# Altium schematic sheet schematic1.SchDoc (part 2 of 3) (continued)
## Nets (continued)
analog_out_68: U2.23(PA0-WKUP) U8.B4(VOUT3) U?#77.1(Vout)
analog_out_69: U3.77(PA15/JTDI) U8.D2(VOUT4) U?#92.1(Vout)
analog_out_70: U3.78(PC10(USART4_TX)) U8.A3(VOUT5) U?#98.1(Vout)
analog_out_71: U3.79(PC11(USART4_RX)) U8.E2(VOUT6) U?#112.1(Vout)
analog_out_72: U3.80(PC12(SDIO_CLK)) U8.A2(VOUT7) U?#117.1(Vout)
analog_out_73: U3.81(PD0) U8.A10(VOUT8) U?#132.1(Vout)
analog_out_74: U3.82(PD1) U8.C11(VOUT9) U?#137.1(Vout)
analog_out_75: U3.83(PD2(SDIO_CMD)) U8.A11(VOUT10) U?#152.1(Vout)
analog_out_76: U3.84(PD3) U8.D11(VOUT11) U?#157.1(Vout)
analog_out_77: U3.85(PD4) U8.B10(VOUT12) U?#172.1(Vout)
analog_out_78: U3.86(PD5(USART2_TX)) U8.E11(VOUT13) U?#177.1(Vout)
analog_out_79: U3.87(PD6(USART2_RX)) U8.A12(VOUT14) U?#192.1(Vout)
analog_out_80: U3.88(PD7) U8.F11(VOUT15) U?#197.1(Vout)
analog_out_81: U3.89(PB3/JTDO) U9.A1(VOUT0) U?#13.1(Vout)
analog_out_82: U3.90(PB4/JNTRST) U9.B9(VOUT1) U?#28.1(Vout)
analog_out_83: U3.91(PB5) U9.C2(VOUT2) U?#33.1(Vout)
analog_out_84: U3.92(PB6(I2C1_SCL)) U9.B4(VOUT3) U?#47.1(Vout)
analog_out_85: U3.93(PB7(I2C1_SDA)) U9.D2(VOUT4) U?#50.1(Vout)
analog_out_86: U3.95(PB8) U9.A3(VOUT5) U?#60.1(Vout)
analog_out_87: U3.96(PB9) U9.E2(VOUT6) U?#73.1(Vout)
analog_out_88: U3.97(PE0) U9.A2(VOUT7) U?#78.1(Vout)
analog_out_89: U3.98(PE1) U9.A10(VOUT8) U?#93.1(Vout)
analog_out_90: U3.1(PE2) U9.C11(VOUT9) U?#94.1(Vout)
analog_out_91: U3.2(PE3) U9.A11(VOUT10) U?#113.1(Vout)
analog_out_92: U3.3(PE4) U9.D11(VOUT11) U?#118.1(Vout)
analog_out_93: U3.4(PE5) U9.B10(VOUT12) U?#133.1(Vout)
analog_out_94: U3.5(PE6) U9.E11(VOUT13) U?#138.1(Vout)
analog_out_95: U3.7(PC13-TAMPER-RTC) U9.A12(VOUT14) U?#153.1(Vout)
analog_out_96: U3.8(PC14-OSC32_IN) U9.F11(VOUT15) U?#158.1(Vout)
analog_out_97: U3.9(PC15-OSC32_OUT) U10.A1(VOUT0) U?#173.1(Vout)
analog_out_98: U3.15(PC0(ADC123_IN10)) U10.B9(VOUT1) U?#178.1(Vout)
analog_out_99: U3.16(PC1(ADC123_IN11)) U10.C2(VOUT2) U?#193.1(Vout)
analog_out_100: U3.17(PC2(ADC123_IN12)) U10.B4(VOUT3) U?#198.1(Vout)
AVDD18: C?#155.2 C?#156.2 C?#157.2 C?#158.2 FL?#2.1 U?#6.15(AVDD18-1) U?#6.22(AVDD18) U?#6.30(AVDDC18)
D1_N: J?#1.2(TRD1-) U?#6.23(MDIN[0])
D1_P: J?#1.1(TRD1+) U?#6.24(MDIP[0])
D2_N: J?#1.4(TRD2-) U?#6.19(MDIN[1])
D2_P: J?#1.3(TRD2+) U?#6.20(MDIP[1])
D3_N: J?#1.6(TRD3-) U?#6.17(MDIN[2])
D3_P: J?#1.5(TRD3+) U?#6.18(MDIP[2])
D4_N: J?#1.8(TRD4-) U?#6.13(MDIN[3])
D4_P: J?#1.7(TRD4+) U?#6.14(MDIP[3])
dac_clk_1: bank_13.U9(IO_L6N_T0_VREF_13) U4.A6(DSCLK)
dac_clk_2: bank_13.AB11(IO_L8N_T1_13) U5.A6(DSCLK)
dac_clk_3: bank_13.Y10(IO_L10N_T1_13) U6.A6(DSCLK)
dac_clk_4: bank_13.Y8(IO_L12N_T1_MRCC_13) U7.A6(DSCLK)
dac_clk_5: bank_13.AA6(IO_L14N_T2_SRCC_13) U8.A6(DSCLK)
dac_clk_6: bank_13.AB4(IO_L16N_T2_13) U9.A6(DSCLK)
dac_clk_7: bank_13.AA4(IO_L18N_T2_13) U10.A6(DSCLK)
dac_input_1: bank_13.AB12(IO_L7N_T1_13) U4.A7(DDIN)
dac_input_2: bank_13.AB9(IO_L9N_T1_DQS_13) U5.A7(DDIN)
dac_input_3: bank_13.AA8(IO_L11N_T1_SRCC_13) U6.A7(DDIN)
dac_input_4: bank_13.Y5(IO_L13N_T2_MRCC_13) U7.A7(DDIN)
dac_input_5: bank_13.AB1(IO_L15N_T2_DQS_13) U8.A7(DDIN)
dac_input_6: bank_13.AB6(IO_L17N_T2_13) U9.A7(DDIN)
dac_input_7: bank_13.T6(IO_L19N_T3_VREF_13) U10.A7(DDIN)
digital_out_1: U1.77(PA15/JTDI) U?#14.3(~{ER}R)
digital_out_2: U1.78(PC10(USART4_TX)) U?#34.3(~{ER}R)
digital_out_3: U1.79(PC11(USART4_RX)) U?#54.3(~{ER}R)
digital_out_4: U1.80(PC12(SDIO_CLK)) U?#79.3(~{ER}R)
digital_out_5: U1.81(PD0) U?#99.3(~{ER}R)
digital_out_6: U1.82(PD1) U?#119.3(~{ER}R)
digital_out_7: U1.83(PD2(SDIO_CMD)) U?#139.3(~{ER}R)
digital_out_8: U1.84(PD3) U?#159.3(~{ER}R)
digital_out_9: U1.85(PD4) U?#179.3(~{ER}R)
digital_out_10: U1.86(PD5(USART2_TX)) U?#204.3(~{ER}R)
digital_out_11: U1.87(PD6(USART2_RX)) U?#15.3(~{ER}R)
digital_out_12: U1.88(PD7) U?#35.3(~{ER}R)
digital_out_13: U1.89(PB3/JTDO) U?#55.3(~{ER}R)
digital_out_14: U1.90(PB4/JNTRST) U?#80.3(~{ER}R)
digital_out_15: U1.91(PB5) U?#106.3(~{ER}R)
digital_out_16: U1.92(PB6(I2C1_SCL)) U?#120.3(~{ER}R)
digital_out_17: U1.93(PB7(I2C1_SDA)) U?#140.3(~{ER}R)
digital_out_18: U1.95(PB8) U?#160.3(~{ER}R)
digital_out_19: U1.96(PB9) U?#180.3(~{ER}R)
digital_out_20: U1.97(PE0)
digital_out_21: U1.98(PE1) U?#16.3(~{ER}R)
digital_out_22: U1.1(PE2) U?#36.3(~{ER}R)
digital_out_23: U1.2(PE3)
digital_out_24: U1.3(PE4) U?#84.3(~{ER}R)
digital_out_25: U1.4(PE5) U?#100.3(~{ER}R)
digital_out_26: U1.5(PE6) U?#121.3(~{ER}R)
digital_out_27: U1.7(PC13-TAMPER-RTC) U?#141.3(~{ER}R)
digital_out_28: U1.8(PC14-OSC32_IN) U?#161.3(~{ER}R)
digital_out_29: U1.9(PC15-OSC32_OUT) U?#181.3(~{ER}R)
digital_out_30: U1.15(PC0(ADC123_IN10)) U?#208.3(~{ER}R)
digital_out_31: U1.16(PC1(ADC123_IN11)) U?#17.3(~{ER}R)
digital_out_32: U1.17(PC2(ADC123_IN12)) U?#37.3(~{ER}R)
digital_out_33: U1.18(PC3(ADC123_IN13)) U?#62.3(~{ER}R)
digital_out_34: U1.23(PA0-WKUP) U?#85.3(~{ER}R)
digital_out_35: U?#101.3(~{ER}R)
digital_out_36: U?#122.3(~{ER}R)
digital_out_37: U?#142.3(~{ER}R)
digital_out_38: U?#162.3(~{ER}R)
digital_out_39: U?#182.3(~{ER}R)
digital_out_40: U?#199.3(~{ER}R)
digital_out_41: U?#18.3(~{ER}R)
digital_out_42: U?#38.3(~{ER}R)
digital_out_43: U?#63.3(~{ER}R)
digital_out_44: U?#81.3(~{ER}R)
digital_out_45: U?#102.3(~{ER}R)
digital_out_46: U?#123.3(~{ER}R)
digital_out_47: U?#143.3(~{ER}R)
digital_out_48: U?#163.3(~{ER}R)
digital_out_49: U?#183.3(~{ER}R)
digital_out_50: U?#200.3(~{ER}R)
digital_out_51: U?#19.3(~{ER}R)
digital_out_52: U?#39.3(~{ER}R)
digital_out_53: U?#64.3(~{ER}R)
digital_out_54: U?#82.3(~{ER}R)
digital_out_55: U?#103.3(~{ER}R)
digital_out_56: U?#124.3(~{ER}R)
digital_out_57: U?#144.3(~{ER}R)
digital_out_58: U?#164.3(~{ER}R)
digital_out_59: U?#184.3(~{ER}R)
digital_out_60: U?#201.3(~{ER}R)
digital_out_61: U?#20.3(~{ER}R)
digital_out_62: U?#40.3(~{ER}R)
digital_out_63: U?#65.3(~{ER}R)
digital_out_64: U?#83.3(~{ER}R)
digital_out_65: U?#104.3(~{ER}R)
digital_out_66: U?#125.3(~{ER}R)
digital_out_67: U?#145.3(~{ER}R)
digital_out_68: U?#165.3(~{ER}R)
digital_out_69: U?#185.3(~{ER}R)
digital_out_70: U?#202.3(~{ER}R)
digital_out_71: U?#21.3(~{ER}R)
digital_out_72: U?#41.3(~{ER}R)
digital_out_73: U?#66.3(~{ER}R)
digital_out_74: U?#86.3(~{ER}R)
digital_out_75: U?#107.3(~{ER}R)
digital_out_76: U?#126.3(~{ER}R)
digital_out_77: U?#146.3(~{ER}R)
digital_out_78: U?#167.3(~{ER}R)
digital_out_79: U?#187.3(~{ER}R)
digital_out_80: U?#206.3(~{ER}R)
digital_out_81: U?#22.3(~{ER}R)
digital_out_82: U?#42.3(~{ER}R)
digital_out_83: U?#67.3(~{ER}R)
digital_out_84: U?#87.3(~{ER}R)
digital_out_85: U?#108.3(~{ER}R)
digital_out_86: U?#127.3(~{ER}R)
digital_out_87: U?#147.3(~{ER}R)
digital_out_88: U?#168.3(~{ER}R)
digital_out_89: U?#188.3(~{ER}R)
ETH-LDL: J?#1.12(YK) R?#172.1
ETH-LDR: J?#1.14(GK) R?#174.1
ETH-MDC: U?#5.A8(PS_MIO20_501) U?#6.4(MDC) ; port ETH-MDC
ETH-MDIO: R?#178.1 U?#5.E10(PS_MIO19_501) U?#6.5(MDIO) ; port ETH-MDIO
ETH-RXCK: U?#5.A6(PS_MIO13_500) U?#6.40(RX_CLK) ; port ETH-RXCK
ETH-RXCTL: U?#5.A7(PS_MIO18_501) U?#6.37(RX_CTRL) ; port ETH-RXCTL
ETH-RXD0: U?#5.B6(PS_MIO14_500) U?#6.38(RXD[0]) ; port ETH-RXD0
ETH-RXD1: U?#5.E6(PS_MIO15_500) U?#6.39(RXD[1]) ; port ETH-RXD1
ETH-RXD2: U?#5.D6(PS_MIO16_501) U?#6.41(RXD[2]) ; port ETH-RXD2
ETH-RXD3: U?#5.E9(PS_MIO17_501) U?#6.42(RXD[3]) ; port ETH-RXD3
ETH-TXCK: U?#5.D5(PS_MIO7_500) ; port ETH-TXCK
ETH-TXCK: U?#6.47(TX_CLK) ; port ETH_TXCK  [a separate net that carries the same name]
ETH-TXCTL: U?#5.C5(PS_MIO12_500) U?#6.2(TX_CTRL) ; port ETH-TXCTL
ETH-TXD0: U?#5.E5(PS_MIO8_500) U?#6.44(TXD[0]) ; port ETH-TXD0
ETH-TXD1: U?#5.C4(PS_MIO9_500) U?#6.45(TXD[1]) ; port ETH-TXD1
ETH-TXD2: U?#5.G7(PS_MIO10_500) U?#6.48(TXD[2]) ; port ETH-TXD2
ETH-TXD3: U?#5.B4(PS_MIO11_500) U?#6.1(TXD[3]) ; port ETH-TXD3
ETHAVDD: C?#161.1 FL?#3.2
in_a_1: p5.1 U4.M4(VIN0)
in_a_2: p5.2 U4.L5(VIN1)
in_a_3: p5.3 U4.L3(VIN2)
in_a_4: p5.4 U4.L4(VIN3)
in_a_5: p5.5 U4.L2(VIN4)
in_a_6: p5.6 U4.G2(VIN5)
in_a_7: p5.7 U4.K2(VIN6)
in_a_8: p5.8 U4.J2(VIN7)
in_a_9: p5.9 U4.B2(VIN8)
in_a_10: p5.10 U4.B3(VIN9)
in_a_11: p5.11 U4.B11(VIN10)
in_a_12: p5.12 U4.L11(VIN11)
in_a_13: p5.13 U4.B12(VIN12)
in_a_14: p5.14 U4.L10(VIN13)
in_a_15: p5.15 U4.K11(VIN14)
in_a_16: p5.16 U4.H11(VIN15)
in_a_17: p5.17 U5.M4(VIN0)
in_a_18: p5.18 U5.L5(VIN1)
in_a_19: p5.19 U5.L3(VIN2)
in_a_20: p5.20 U5.L4(VIN3)
in_a_21: p5.21 U5.L2(VIN4)
in_a_22: p5.22 U5.G2(VIN5)
in_a_23: p5.23 U5.K2(VIN6)
in_a_24: p5.24 U5.J2(VIN7)
in_a_25: p5.25 U5.B2(VIN8)
in_a_26: p5.26 U5.B3(VIN9)
in_a_27: p5.27 U5.B11(VIN10)
in_a_28: p5.28 U5.L11(VIN11)
in_a_29: p5.29 U5.B12(VIN12)
in_a_30: p5.30 U5.L10(VIN13)
in_a_31: p?#6.1 U5.K11(VIN14)
in_a_32: p?#6.2 U5.H11(VIN15)
in_a_33: p?#6.3 U6.M4(VIN0)
in_a_34: p?#6.4 U6.L5(VIN1)
in_a_35: p?#6.5 U6.L3(VIN2)
in_a_36: p?#6.6 U6.L4(VIN3)
in_a_37: p?#6.7 U6.L2(VIN4)
in_a_38: p?#6.8 U6.G2(VIN5)
in_a_39: p?#6.9 U6.K2(VIN6)
in_a_40: p?#6.10 U6.J2(VIN7)
in_a_41: p?#6.11 U6.B2(VIN8)
in_a_42: p?#6.12 U6.B3(VIN9)
in_a_43: p?#6.13 U6.B11(VIN10)
in_a_44: p?#6.14 U6.L11(VIN11)
in_a_45: p?#6.15 U6.B12(VIN12)
in_a_46: p?#6.16 U6.L10(VIN13)
in_a_47: p?#6.17 U6.K11(VIN14)
in_a_48: p?#6.18 U6.H11(VIN15)
in_a_49: p?#6.19 U7.M4(VIN0)
in_a_50: p?#6.20 U7.L5(VIN1)
in_a_51: p?#6.21 U7.L3(VIN2)
in_a_52: p?#6.22 U7.L4(VIN3)
in_a_53: p?#6.23 U7.L2(VIN4)
in_a_54: p?#6.24 U7.G2(VIN5)
in_a_55: p?#6.25 U7.K2(VIN6)
in_a_56: p?#6.26 U7.J2(VIN7)
in_a_57: p?#6.27 U7.B2(VIN8)
in_a_58: p?#6.28 U7.B3(VIN9)
in_a_59: p?#6.29 U7.B11(VIN10)
in_a_60: p?#6.30 U7.L11(VIN11)
in_a_61: p?#7.1 U7.B12(VIN12)
in_a_62: p?#7.2 U7.L10(VIN13)
in_a_63: p?#7.3 U7.K11(VIN14)
in_a_64: p?#7.4 U7.H11(VIN15)
in_a_65: p?#7.5 U8.M4(VIN0)
in_a_66: p?#7.6 U8.L5(VIN1)
in_a_67: p?#7.7 U8.L3(VIN2)
in_a_68: p?#7.8 U8.L4(VIN3)
in_a_69: p?#7.9 U8.L2(VIN4)
in_a_70: p?#7.10 U8.G2(VIN5)
in_a_71: p?#7.11 U8.K2(VIN6)
in_a_72: p?#7.12 U8.J2(VIN7)
in_a_73: p?#7.13 U8.B2(VIN8)
in_a_74: p?#7.14 U8.B3(VIN9)
in_a_75: p?#7.15 U8.B11(VIN10)
in_a_76: p?#7.16 U8.L11(VIN11)
in_a_77: p?#7.17 U8.B12(VIN12)
in_a_78: p?#7.18 U8.L10(VIN13)
in_a_79: p?#7.19 U8.K11(VIN14)
in_a_80: p?#7.20 U8.H11(VIN15)
in_a_81: p?#7.21 U9.M4(VIN0)
in_a_82: p?#7.22 U9.L5(VIN1)
in_a_83: p?#7.23 U9.L3(VIN2)
in_a_84: p?#7.24 U9.L4(VIN3)
in_a_85: p?#7.25 U9.L2(VIN4)
in_a_86: p?#7.26 U9.G2(VIN5)
in_a_87: p?#7.27 U9.K2(VIN6)
in_a_88: p?#7.28 U9.J2(VIN7)
in_a_89: p?#7.29 U9.B2(VIN8)
in_a_90: p?#7.30 U9.B3(VIN9)
in_a_91: P?#5.1 U9.B11(VIN10)
in_a_92: P?#5.2 U9.L11(VIN11)
in_a_93: P?#5.3 U9.B12(VIN12)
in_a_94: P?#5.4 U9.L10(VIN13)
in_a_95: P?#5.5 U9.K11(VIN14)
in_a_96: P?#5.6 U9.H11(VIN15)
in_a_97: P?#5.7 U10.M4(VIN0)
in_a_98: P?#5.8 U10.L5(VIN1)
in_a_99: P?#5.9 U10.L3(VIN2)
in_a_100: P?#5.10 U10.L4(VIN3)
in_d_1: p1.1 R?#36.2
in_d_2: p1.2 R?#35.2
in_d_3: p1.3 R?#33.2
in_d_4: p1.4 R?#30.2
in_d_5: p1.5 R?#26.2
in_d_6: p1.6 R?#21.2
in_d_7: p1.7 R?#17.2
in_d_8: p1.8 R?#8.2
in_d_9: p1.9 R?#5.2
in_d_10: p1.10 R?#95.2
in_d_11: p1.11 R?#90.2
in_d_12: p1.12 R?#84.2
in_d_13: p1.13 R?#76.2
in_d_14: p1.14 R?#67.2
in_d_15: p1.15 R?#59.2
in_d_16: p1.16 R?#68.1
in_d_17: p1.17 R?#60.1
in_d_18: p1.18 R?#100.2
in_d_19: p1.19 R?#98.2
in_d_20: p1.20 R?#94.2
in_d_21: p1.21 R?#89.2
in_d_22: p1.22 R?#83.2
in_d_23: p1.23 R?#75.2
in_d_24: p1.24 R?#137.2
in_d_25: p1.25 R?#135.2
in_d_26: p1.26 R?#131.2
in_d_27: p1.27 R?#127.2
in_d_28: p1.28 R?#122.2
in_d_29: p1.29 R?#117.2
in_d_30: p1.30 R?#123.1
in_d_31: P2.1 R?#118.1
in_d_32: P2.2 R?#105.1
in_d_33: P2.3 R?#44.2
in_d_34: P2.4 R?#43.2
in_d_35: P2.5 R?#163.2
in_d_36: P2.6 R?#162.2
in_d_37: P2.7 R?#159.2
in_d_38: P2.8 R?#156.2
in_d_39: P2.9 R?#153.2
in_d_40: P2.10 R?#150.2
in_d_41: P2.11 R?#148.2
in_d_42: P2.12 R?#144.2
in_d_43: P2.13 R?#143.2
in_d_44: P2.14 R?#203.2
in_d_45: P2.15 R?#197.2
in_d_46: P2.16 R?#193.2
in_d_47: P2.17 R?#189.2
in_d_48: P2.18 R?#184.2
in_d_49: P2.19 R?#180.2
in_d_50: P2.20 R?#185.1
in_d_51: P2.21 R?#181.1
in_d_52: P2.22 R?#208.2
in_d_53: P2.23 R?#206.2
in_d_54: P2.24 R?#202.2
in_d_55: P2.25 R?#196.2
in_d_56: P2.26 R?#192.2
in_d_57: P2.27 R?#188.2
in_d_58: P2.28 R?#228.2
in_d_59: P2.29 R?#225.2
in_d_60: P2.30 R?#223.2
in_d_61: P3.1 R?#221.2
in_d_62: P3.2 R?#217.2
in_d_63: P3.3 R?#214.2
in_d_64: P3.4 R?#218.1
in_d_65: P3.5 R?#215.1
in_d_66: P3.6 R?#211.1
in_d_67: P3.7 R?#173.2
in_d_68: P3.8 R?#40.2 R?#171.2
in_d_69: P3.9 R?#31.2 R?#39.2
in_d_70: P3.10 R?#27.2
in_d_71: P3.11 R?#22.2
in_d_72: P3.12 R?#18.2
in_d_73: P3.13 R?#13.2
in_d_74: P3.14 R?#9.2
in_d_75: P3.15 R?#6.2
in_d_76: P3.16 R?#2.2
in_d_77: P3.17 R?#1.2
in_d_78: P3.18 R?#78.2
in_d_79: P3.19 R?#70.2
in_d_80: P3.20 R?#62.2
in_d_81: P3.21 R?#55.2
in_d_82: P3.22 R?#50.2
in_d_83: P3.23 R?#46.2
in_d_84: P3.24 R?#51.1
in_d_85: P3.25 R?#47.1
in_d_86: P3.26 R?#91.2
in_d_87: P3.27 R?#85.2
in_d_88: P3.28 R?#77.2
in_d_89: P3.29 R?#69.2
in_d_90: P3.30 R?#61.2
in_d_91: P4.1 R?#54.2
in_d_92: P4.2 R?#128.2
in_d_93: P4.3 R?#124.2
in_d_94: P4.4 R?#119.2
in_d_95: P4.5 R?#114.2
in_d_96: P4.6 R?#111.2
in_d_97: P4.7 R?#108.2
in_d_98: P4.8 R?#112.1
in_d_99: P4.9 R?#109.1
in_d_100: P4.10 R?#102.1
LD-MIO/VCFG0: R?#177.2 U?#5.A3(PS_MIO5_500)
miso_1: bank_13.V9(IO_L1N_T0_13) U1.31(PA6PA4(SPI1_MISO))
miso_2: bank_13.W10(IO_L3N_T0_DQS_13) U2.31(PA6PA4(SPI1_MISO))
miso_3: bank_13.U11(IO_L5N_T0_13) U3.31(PA6PA4(SPI1_MISO))
mosi_1: bank_13.V8(IO_L2P_T0_13) U1.32(PA7PA4(SPI1_MOSI))
mosi_2: bank_13.V12(IO_L4P_T0_13) U2.32(PA7PA4(SPI1_MOSI))
mosi_3: bank_13.U10(IO_L6P_T0_13) U3.32(PA7PA4(SPI1_MOSI))
NLETHAVDD: C?#172.2 C?#173.2
nss_1: bank_13.R7(IO_0_13) U1.29(PA4(SPI1_NSS))
nss_2: bank_13.W8(IO_L2N_T0_13) U2.29(PA4(SPI1_NSS))
nss_3: bank_13.W12(IO_L4N_T0_13) U3.29(PA4(SPI1_NSS))
out_a_1: p?#9.1 U?#9.4(GND)
out_a_2: p?#9.2 U?#24.4(GND)
out_a_3: p?#9.3 U?#29.4(GND)
out_a_4: p?#9.4 U?#48.4(GND)
out_a_5: p?#9.5 U?#51.4(GND)
out_a_6: p?#9.6 U?#56.4(GND)
out_a_7: p?#9.7 U?#69.4(GND)
out_a_8: U?#74.4(GND)
out_a_9: p?#9.9 U?#89.4(GND)
out_a_10: p?#9.10 U?#95.4(GND)
out_a_11: p?#9.11 U?#109.4(GND)
out_a_12: p?#9.12 U?#114.4(GND)
out_a_13: p?#9.13 U?#129.4(GND)
out_a_14: p?#9.14 U?#134.4(GND)
out_a_15: p?#9.15 U?#149.4(GND)
out_a_16: p?#9.16 U?#154.4(GND)
out_a_17: p?#9.17 U?#169.4(GND)
out_a_18: p?#9.18 U?#174.4(GND)
out_a_19: p?#9.19 U?#189.4(GND)
out_a_20: p?#9.20 U?#194.4(GND)
out_a_21: p?#9.21 U?#10.4(GND)
out_a_22: p?#9.22 U?#25.4(GND)
out_a_23: p?#9.23 U?#30.4(GND)
out_a_24: U?#44.4(GND)
out_a_25: p?#9.25 U?#52.4(GND)
out_a_26: p?#9.26 U?#57.4(GND)
out_a_27: p?#9.27 U?#70.4(GND)
out_a_28: p?#9.28 U?#75.4(GND)
out_a_29: p?#9.29 U?#90.4(GND)
out_a_30: p?#9.30 U?#96.4(GND)
out_a_31: p?#10.1 U?#110.4(GND)
out_a_32: p?#10.2 U?#115.4(GND)
out_a_33: p?#10.3 U?#130.4(GND)
out_a_34: p?#10.4 U?#135.4(GND)
out_a_35: p?#10.5 U?#150.4(GND)
out_a_36: p?#10.6 U?#155.4(GND)
out_a_37: p?#10.7 U?#170.4(GND)
out_a_38: p?#10.8 U?#175.4(GND)
out_a_39: p?#10.9 U?#190.4(GND)
out_a_40: p?#10.10 U?#195.4(GND)
out_a_41: p?#10.11 U?#11.4(GND)
out_a_42: p?#10.12 U?#26.4(GND)
out_a_43: p?#10.13 U?#31.4(GND)
out_a_44: p?#10.14 U?#45.4(GND)
out_a_45: p?#10.15 U?#53.4(GND)
out_a_46: p?#10.16 U?#58.4(GND)
out_a_47: p?#10.17 U?#71.4(GND)
out_a_48: p?#10.18 U?#76.4(GND)
out_a_49: p?#10.19 U?#91.4(GND)
out_a_50: p?#10.20 U?#97.4(GND)
out_a_51: p?#10.21 U?#111.4(GND)
out_a_52: p?#10.22 U?#116.4(GND)
out_a_53: p?#10.23 U?#131.4(GND)
out_a_54: p?#10.24 U?#136.4(GND)
out_a_55: p?#10.25 U?#151.4(GND)
out_a_56: p?#10.26 U?#156.4(GND)
out_a_57: p?#10.27 U?#171.4(GND)
out_a_58: p?#10.28 U?#176.4(GND)
out_a_59: p?#10.29 U?#191.4(GND)
out_a_60: p?#10.30 U?#196.4(GND)
out_a_61: p?#11.1 U?#12.4(GND)
out_a_62: p?#11.2 U?#27.4(GND)
out_a_63: p?#11.3 U?#32.4(GND)
out_a_64: p?#11.4 U?#46.4(GND)
out_a_65: p?#11.5 U?#49.4(GND)
out_a_66: p?#11.6 U?#59.4(GND)
out_a_67: p?#11.7 U?#72.4(GND)
out_a_68: p?#11.8 U?#77.4(GND)
out_a_69: p?#11.9 U?#92.4(GND)
out_a_70: p?#11.10 U?#98.4(GND)
out_a_71: p?#11.11 U?#112.4(GND)
out_a_72: p?#11.12 U?#117.4(GND)
out_a_73: p?#11.13 U?#132.4(GND)
out_a_74: p?#11.14 U?#137.4(GND)
out_a_75: p?#11.15 U?#152.4(GND)
out_a_76: p?#11.16 U?#157.4(GND)
out_a_77: p?#11.17 U?#172.4(GND)
out_a_78: p?#11.18 U?#177.4(GND)
out_a_79: p?#11.19 U?#192.4(GND)
out_a_80: p?#11.20 U?#197.4(GND)
out_a_81: p?#11.21 U?#13.4(GND)
out_a_82: p?#11.22 U?#28.4(GND)
out_a_83: p?#11.23 U?#33.4(GND)
out_a_84: p?#11.24 U?#47.4(GND)
out_a_85: p?#11.25 U?#50.4(GND)
out_a_86: p?#11.26 U?#60.4(GND)
out_a_87: p?#11.27 U?#73.4(GND)
out_a_88: p?#11.28 U?#78.4(GND)
out_a_89: p?#11.29 U?#93.4(GND)
out_a_90: p?#11.30 U?#94.4(GND)
out_a_91: P?#8.1 U?#113.4(GND)
out_a_92: P?#8.2 U?#118.4(GND)
out_a_93: P?#8.3 U?#133.4(GND)
out_a_94: P?#8.4 U?#138.4(GND)
out_a_95: P?#8.5 U?#153.4(GND)
out_a_96: P?#8.6 U?#158.4(GND)
out_a_97: P?#8.7 U?#173.4(GND)
out_a_98: P?#8.8 U?#178.4(GND)
out_a_99: P?#8.9 U?#193.4(GND)
out_a_100: P?#8.10 U?#198.4(GND)
out_d_1: p?#2.1 Q?#1.3(S) R?#239.2 U?#14.4(GND)
out_d_2: p?#2.2 Q?#11.3(S) R?#252.2 U?#34.4(GND)
out_d_3: p?#2.3 Q?#21.3(S) R?#264.2 U?#54.4(GND)
out_d_4: p?#2.4 Q?#31.3(S) R?#274.2 U?#79.4(GND)
out_d_5: p?#2.5 Q?#41.3(S) R?#290.2 U?#99.4(GND)
out_d_6: p?#2.6 Q?#51.3(S) R?#310.2 U?#119.4(GND)
out_d_7: p?#2.7 Q?#61.3(S) R?#320.2 U?#139.4(GND)
out_d_8: p?#2.8 Q?#71.3(S) R?#332.2 U?#159.4(GND)
out_d_9: p?#2.9 Q?#81.3(S) R?#344.2 U?#179.4(GND)
out_d_10: p?#2.10 Q?#96.3(S) R?#359.2 U?#204.4(GND)
out_d_11: p?#2.11 Q?#2.3(S) R?#240.2 U?#15.4(GND)
out_d_12: p?#2.12 Q?#12.3(S) R?#253.2 U?#35.4(GND)
out_d_13: p?#2.13 Q?#22.3(S) R?#265.2 U?#55.4(GND)
out_d_14: p?#2.14 Q?#32.3(S) R?#275.2 U?#80.4(GND)
out_d_15: p?#2.15 Q?#48.3(S) R?#297.2 U?#106.4(GND)
out_d_16: p?#2.16 Q?#52.3(S) R?#311.2 U?#120.4(GND)
out_d_17: p?#2.17 Q?#62.3(S) R?#321.2 U?#140.4(GND)
out_d_18: p?#2.18 Q?#72.3(S) R?#333.2 U?#160.4(GND)
out_d_19: p?#2.19 Q?#82.3(S) R?#345.2 U?#180.4(GND)
out_d_20: p?#2.20 Q?#97.3(S) R?#360.2 U?#205.4(GND)
out_d_21: p?#2.21 Q?#3.3(S) R?#241.2 U?#16.4(GND)
out_d_22: p?#2.22 Q?#13.3(S) R?#254.2 U?#36.4(GND)
out_d_23: p?#2.23 Q?#23.3(S) R?#266.2 U?#61.4(GND)
out_d_24: p?#2.24 Q?#36.3(S) R?#280.2 U?#84.4(GND)
out_d_25: p?#2.25 Q?#42.3(S) R?#291.2 U?#100.4(GND)
out_d_26: p?#2.26 Q?#53.3(S) R?#312.2 U?#121.4(GND)
out_d_27: p?#2.27 Q?#63.3(S) R?#322.2 U?#141.4(GND)
out_d_28: p?#2.28 Q?#73.3(S) R?#334.2 U?#161.4(GND)
out_d_29: p?#2.29 Q?#83.3(S) R?#346.2 U?#181.4(GND)
out_d_30: p?#2.30 Q?#100.3(S) R?#363.2 U?#208.4(GND)
out_d_31: p?#3.1 Q?#4.3(S) R?#242.2 U?#17.4(GND)
out_d_32: p?#3.2 Q?#14.3(S) R?#255.2 U?#37.4(GND)
out_d_33: p?#3.3 Q?#24.3(S) R?#267.2 U?#62.4(GND)
out_d_34: p?#3.4 Q?#37.3(S) R?#281.2 U?#85.4(GND)
out_d_35: p?#3.5 Q?#43.3(S) R?#292.2 U?#101.4(GND)
out_d_36: p?#3.6 Q?#54.3(S) R?#313.2 U?#122.4(GND)
out_d_37: p?#3.7 Q?#64.3(S) R?#323.2 U?#142.4(GND)
out_d_38: p?#3.8 Q?#74.3(S) R?#335.2 U?#162.4(GND)
out_d_39: p?#3.9 Q?#84.3(S) R?#347.2 U?#182.4(GND)
out_d_40: p?#3.10 Q?#91.3(S) R?#354.2 U?#199.4(GND)
out_d_41: p?#3.11 Q?#5.3(S) R?#243.2 U?#18.4(GND)
out_d_42: p?#3.12 Q?#15.3(S) R?#256.2 U?#38.4(GND)
out_d_43: p?#3.13 Q?#25.3(S) R?#268.2 U?#63.4(GND)
out_d_44: p?#3.14 Q?#33.3(S) R?#276.2 U?#81.4(GND)
out_d_45: p?#3.15 Q?#44.3(S) R?#293.2 U?#102.4(GND)
out_d_46: p?#3.16 Q?#55.3(S) R?#314.2 U?#123.4(GND)
out_d_47: p?#3.17 Q?#65.3(S) R?#324.2 U?#143.4(GND)
out_d_48: p?#3.18 Q?#75.3(S) R?#336.2 U?#163.4(GND)
out_d_49: p?#3.19 Q?#85.3(S) R?#348.2 U?#183.4(GND)
out_d_50: p?#3.20 Q?#92.3(S) R?#355.2 U?#200.4(GND)
out_d_51: p?#3.21 Q?#6.3(S) R?#244.2 U?#19.4(GND)
out_d_52: p?#3.22 Q?#16.3(S) R?#257.2 U?#39.4(GND)
out_d_53: p?#3.23 Q?#26.3(S) R?#269.2 U?#64.4(GND)
out_d_54: p?#3.24 Q?#34.3(S) R?#277.2 U?#82.4(GND)
out_d_55: p?#3.25 Q?#45.3(S) R?#294.2 U?#103.4(GND)
out_d_56: p?#3.26 Q?#56.3(S) R?#315.2 U?#124.4(GND)
out_d_57: p?#3.27 Q?#66.3(S) R?#325.2 U?#144.4(GND)
out_d_58: p?#3.28 Q?#76.3(S) R?#337.2 U?#164.4(GND)
out_d_59: p?#3.29 Q?#86.3(S) R?#349.2 U?#184.4(GND)
out_d_60: p?#3.30 Q?#93.3(S) R?#356.2 U?#201.4(GND)
out_d_61: p?#4.1 Q?#7.3(S) R?#245.2 U?#20.4(GND)
out_d_62: p?#4.2 Q?#17.3(S) R?#258.2 U?#40.4(GND)
out_d_63: p?#4.3 Q?#27.3(S) R?#270.2 U?#65.4(GND)
out_d_64: p?#4.4 Q?#35.3(S) R?#278.2 U?#83.4(GND)
out_d_65: p?#4.5 Q?#46.3(S) R?#295.2 U?#104.4(GND)
out_d_66: p?#4.6 Q?#57.3(S) R?#316.2 U?#125.4(GND)
out_d_67: p?#4.7 Q?#67.3(S) R?#326.2 U?#145.4(GND)
out_d_68: p?#4.8 Q?#77.3(S) R?#338.2 U?#165.4(GND)
out_d_69: p?#4.9 Q?#87.3(S) R?#350.2 U?#185.4(GND)
out_d_70: p?#4.10 Q?#94.3(S) R?#357.2 U?#202.4(GND)
out_d_71: p?#4.11 Q?#8.3(S) R?#246.2 U?#21.4(GND)
out_d_72: p?#4.12 Q?#18.3(S) R?#259.2 U?#41.4(GND)
out_d_73: p?#4.13 Q?#28.3(S) R?#271.2 U?#66.4(GND)
out_d_74: p?#4.14 Q?#38.3(S) R?#282.2 U?#86.4(GND)
out_d_75: p?#4.15 Q?#49.3(S) R?#298.2 U?#107.4(GND)
out_d_76: p?#4.16 Q?#58.3(S) R?#317.2 U?#126.4(GND)
out_d_77: p?#4.17 Q?#68.3(S) R?#327.2 U?#146.4(GND)
out_d_78: p?#4.18 Q?#79.3(S) R?#340.2 U?#167.4(GND)
out_d_79: p?#4.19 Q?#89.3(S) R?#352.2 U?#187.4(GND)
out_d_80: p?#4.20 Q?#98.3(S) R?#361.2 U?#206.4(GND)
out_d_81: p?#4.21 Q?#9.3(S) R?#247.2 U?#22.4(GND)
out_d_82: p?#4.22 Q?#19.3(S) R?#260.2 U?#42.4(GND)
out_d_83: p?#4.23 Q?#29.3(S) R?#272.2 U?#67.4(GND)
out_d_84: p?#4.24 Q?#39.3(S) R?#283.2 U?#87.4(GND)
out_d_85: p?#4.25 Q?#50.3(S) R?#299.2 U?#108.4(GND)
out_d_86: p?#4.26 Q?#59.3(S) R?#318.2 U?#127.4(GND)
out_d_87: p?#4.27 Q?#69.3(S) R?#328.2 U?#147.4(GND)
out_d_88: p?#4.28 Q?#80.3(S) R?#341.2 U?#168.4(GND)
out_d_89: p?#4.29 Q?#90.3(S) R?#353.2 U?#188.4(GND)
out_d_90: p?#4.30 Q?#99.3(S) R?#362.2 U?#207.4(GND)
out_d_91: P?#1.1 Q?#10.3(S) R?#248.2 U?#23.4(GND)
out_d_92: P?#1.2 Q?#20.3(S) R?#261.2 U?#43.4(GND)
out_d_93: P?#1.3 Q?#30.3(S) R?#273.2 U?#68.4(GND)
out_d_94: P?#1.4 Q?#40.3(S) R?#284.2 U?#88.4(GND)
out_d_95: P?#1.5 Q?#47.3(S) R?#296.2 U?#105.4(GND)
out_d_96: P?#1.6 Q?#60.3(S) R?#319.2 U?#128.4(GND)
out_d_97: P?#1.7 Q?#70.3(S) R?#329.2 U?#148.4(GND)
out_d_98: P?#1.8 Q?#78.3(S) R?#339.2 U?#166.4(GND)
out_d_99: P?#1.9 Q?#88.3(S) R?#351.2 U?#186.4(GND)
out_d_100: P?#1.10 Q?#95.3(S) R?#358.2 U?#203.4(GND)
PROG: R?#226.1 S?#4.1 S?#4.2 U?#7.T11(PROGRAM_B_0)
PROG-RST: J?#6.14
PS-CLK: R?#219.2 U?#5.F7(PS_CLK_500)
PS-POR-B: D?#6.C
PS-RST: R?#132.1 S?#2.1 S?#2.2 U?#5.C9(PS_SRST_B_501)
sck_1: bank_13.V10(IO_L1P_T0_13) U1.30(PA5PA4(SPI1_SCK))
sck_2: bank_13.W11(IO_L3P_T0_DQS_13) U2.30(PA5PA4(SPI1_SCK))
sck_3: bank_13.U12(IO_L5P_T0_13) U3.30(PA5PA4(SPI1_SCK))
SHIELD: J?#1.S1(SHIELD) J?#1.S2(SHIELD) J?#1.S3(SHIELD) J?#1.S4(SHIELD) J?#1.S5(SHIELD) J?#1.S6(SHIELD) J?#1.S7(SHIELD) J?#1.S8(SHIELD)
SPI-CS: U?#5.G6(PS_MIO0_500) U?#8.1(~{CS})
SPI-IO0/MODE0: R?#142.1 U?#5.A1(PS_MIO1_500) U?#8.5(SI/IO0)
SPI-IO1/MODE1: R?#145.1 U?#8.2(SO/IO1)
SPI-IO2/MODE2: R?#157.1 U?#5.A2(PS_MIO2_500) U?#8.3(~{WP}/IO2)
SPI-IO3/MODE3: R?#165.1 U?#5.F6(PS_MIO3_500) U?#8.7(IO3/~{RESET})
SPI-SCK/MODE4: R?#140.2 R?#169.1 U?#8.6(SCK)
SPI-SCLK-FB/VCFG1: R?#141.1 U?#5.A4(PS_MIO6_500)
swclk_1: U1.76(PA14/JTCK/SWCLK)
swclk_2: U2.76(PA14/JTCK/SWCLK)
swclk_3: U3.76(PA14/JTCK/SWCLK)
swdio_1: U1.72(PA13/JTMS/SWDIO)
swdio_2: U2.72(PA13/JTMS/SWDIO)
swdio_3: U3.72(PA13/JTMS/SWDIO)
TCK: R?#164.2 U?#7.G11(TCK_0)
TCK-JTAG: D?#4.C(K) J?#6.06 R?#164.1
TDI-JTAG: D?#3.C(K) J?#6.10 R?#166.1
TDI-USB: R?#167.2
TDO-FPGA: U?#7.G14(TDO_0)
TDO-JTAG: D?#1.C(K) J?#6.08 R?#167.1
TDO-USB/TDI-FPGA: R?#166.2 U?#7.H13(TDI_0)
TMS: R?#160.2 U?#7.G12(TMS_0)
TMS-JTAG: D?#2.C(K) J?#6.04 R?#160.1
uart_rx_1: bank_13.U4(IO_L20N_T3_13) R?#262.1
uart_rx_2: bank_13.V4(IO_L21N_T3_DQS_13) R?#263.1
uart_rx_3: bank_13.U5(IO_L22N_T3_13) R?#279.1
uart_rx_4: bank_13.W7(IO_L23N_T3_13) R?#285.1
uart_rx_5: bank_13.W5(IO_L24N_T3_13) R?#308.1
uart_rx_6: bank33.U19(IO_0_33) R?#309.1
uart_rx_7: bank33.U21(IO_L1N_T0_33) R?#330.1
uart_rx_8: bank33.U22(IO_L2N_T0_33) R?#331.1
uart_rx_9: bank33.W22(IO_L3N_T0_DQS_33) R?#342.1
uart_rx_10: bank33.W21(IO_L4N_T0_33) R?#343.1
uart_tx_1: bank_13.V5(IO_L21P_T3_DQS_13) U11.11(T1IN)
uart_tx_2: bank_13.U6(IO_L22P_T3_13) U11.10(T2IN)
uart_tx_3: bank_13.V7(IO_L23P_T3_13) U12.11(T1IN)
uart_tx_4: bank_13.W6(IO_L24P_T3_13) U12.10(T2IN)
uart_tx_5: bank_13.U7(IO_25_13) U13.11(T1IN)
uart_tx_6: bank33.T21(IO_L1P_T0_33) U13.10(T2IN)
uart_tx_7: bank33.T22(IO_L2P_T0_33) U14.11(T1IN)
uart_tx_8: bank33.V22(IO_L3P_T0_DQS_33) U14.10(T2IN)
uart_tx_9: bank33.W20(IO_L4P_T0_33) U15.11(T1IN)
uart_tx_10: bank33.U20(IO_L5P_T0_33) U15.10(T2IN)
VCC1V0: C?#169.2 C?#170.2 C?#171.2
VCC1V8: C?#162.2 C?#163.2 C?#164.2 FL?#2.2 R?#178.2 R?#198.2
VCCPLL: C?#151.2 FL?#1.1 U?#4.H10(VCCPLL)
XAD0-AD0_N: J?#8.06
XAD-AD8_P: J?#8.08
XADC-5V0: J?#8.13
XADC-AD0_P: J?#8.03
XADC-AD8_N: J?#8.07
XADC-AGND: C?#159.1 U?#7.L12(VREFN_0)
XADC-DXN: J?#8.12 U?#7.N12(DXN_0)
XADC-DXP: J?#8.09 U?#7.N11(DXP_0)
XADC-GIO0: J?#8.18
XADC-GIO1: J?#8.17
XADC-GIO2: J?#8.20
XADC-GIO3: J?#8.19
XADC-GND: J?#8.04 J?#8.05 J?#8.10
XADC-VCC: J?#8.14
XADC-VN: J?#8.01 R?#232.1
XADC-VN-R: C?#168.2 R?#232.2 U?#7.M12(VN_0)
XADC-VP: J?#8.02 R?#230.1
XADC-VP-R: C?#168.1 R?#230.2 U?#7.L11(VP_0)
XADC-VREFP: J?#8.11
XADC_VCC: C?#67.2 U?#4.K11(VCCADC_0)
XTAL_IN: C?#154.2 U?#6.29(XTAL_IN) Y?#2.3
XTAL_OUT: C?#153.2 U?#6.28(XTAL_OUT) Y?#2.1
NetC1_2: C1.2 U1.12(OSC_IN) Y1.1(OSC1)
NetC2_2: C2.2 U1.13(OSC_OUT) Y1.2(OSC2)
NetC?#66_2: C?#66.2 U3.12(OSC_IN) Y?#1.1(OSC1)
NetC?#79_2: C?#79.2 U3.13(OSC_OUT) Y?#1.2(OSC2)
NetC?#89_1: C?#89.1 C?#90.1 C?#91.1 C?#92.1 C?#93.1 C?#94.1 C?#95.1
NetC?#110_2: C?#110.2 S?#1.2 U3.14(NRST)
NetC?#122_2: C?#122.2 S1.2 U1.14(NRST)
NetC?#145_1: C?#145.1 C?#146.1 C?#147.1 C?#148.1 C?#149.2 C?#150.2
NetC?#152_2: C?#152.2 U2.12(OSC_IN) Y?#3.1(OSC1)
NetC?#160_2: C?#160.2 U2.13(OSC_OUT) Y?#3.2(OSC2)
NetC?#165_2: C?#165.2 S?#3.2 U2.14(NRST)
NetC?#192_1: C?#192.1 U11.2(V+)
NetC?#193_1: C?#193.1 U11.1(C1+)
NetC?#193_2: C?#193.2 U11.3(C1-)
NetC?#194_1: C?#194.1 U11.5(C2-)
NetC?#194_2: C?#194.2 U11.4(C2+)
NetC?#195_2: C?#195.2 U11.6(V-)
NetC?#196_1: C?#196.1 U12.2(V+)
NetC?#197_1: C?#197.1 U12.1(C1+)
NetC?#197_2: C?#197.2 U12.3(C1-)
NetC?#198_1: C?#198.1 U12.5(C2-)
NetC?#198_2: C?#198.2 U12.4(C2+)
NetC?#199_2: C?#199.2 U12.6(V-)
NetC?#208_1: C?#208.1 U13.2(V+)
NetC?#209_1: C?#209.1 U13.1(C1+)
NetC?#209_2: C?#209.2 U13.3(C1-)
NetC?#218_1: C?#218.1 U13.5(C2-)
NetC?#218_2: C?#218.2 U13.4(C2+)
NetC?#227_2: C?#227.2 U13.6(V-)
NetC?#228_1: C?#228.1 U14.2(V+)
NetC?#229_1: C?#229.1 U14.1(C1+)
NetC?#229_2: C?#229.2 U14.3(C1-)
NetC?#230_1: C?#230.1 U14.5(C2-)
NetC?#230_2: C?#230.2 U14.4(C2+)
NetC?#231_2: C?#231.2 U14.6(V-)
NetC?#232_1: C?#232.1 U15.2(V+)
NetC?#233_1: C?#233.1 U15.1(C1+)
NetC?#233_2: C?#233.2 U15.3(C1-)
NetC?#234_1: C?#234.1 U15.5(C2-)
NetC?#234_2: C?#234.2 U15.4(C2+)
NetC?#235_2: C?#235.2 U15.6(V-)
NetD?#5_A: D?#5.A R?#176.1 U?#7.T12(DONE_0)
NetD?#6_A: D?#6.A R?#198.1 U?#6.12(RESETN)
NetJ1_2: J1.2 U11.14(T1OUT)
NetJ1_3: J1.3 U11.13(R1IN)
NetJ2_2: J2.2 U11.7(T2OUT)
NetJ2_3: J2.3 U11.8(R2IN)
NetJ?#2_2: J?#2.2 R?#142.2
NetJ?#3_2: J?#3.2 R?#145.2
NetJ?#4_2: J?#4.2 R?#157.2
NetJ?#5_2: J?#5.2 R?#165.2
NetJ?#7_2: J?#7.2 R?#169.2
NetJ?#9_2: J?#9.2 U12.14(T1OUT)
NetJ?#9_3: J?#9.3 U12.13(R1IN)
NetJ?#10_2: J?#10.2 U12.7(T2OUT)
NetJ?#10_3: J?#10.3 U12.8(R2IN)
NetJ?#11_2: J?#11.2 U13.14(T1OUT)
NetJ?#11_3: J?#11.3 U13.13(R1IN)
NetJ?#12_2: J?#12.2 U13.7(T2OUT)
NetJ?#12_3: J?#12.3 U13.8(R2IN)
NetJ?#13_2: J?#13.2 U14.14(T1OUT)
NetJ?#13_3: J?#13.3 U14.13(R1IN)
NetJ?#14_2: J?#14.2 U14.7(T2OUT)
NetJ?#14_3: J?#14.3 U14.8(R2IN)
NetJ?#15_2: J?#15.2 U15.14(T1OUT)
NetJ?#15_3: J?#15.3 U15.13(R1IN)
NetJ?#16_2: J?#16.2 U15.7(T2OUT)
NetJ?#16_3: J?#16.3 U15.8(R2IN)
NetQ?#1_2: Q?#1.2(G) U?#14.1(Vout)
NetQ?#2_2: Q?#2.2(G) U?#15.1(Vout)
NetQ?#3_2: Q?#3.2(G) U?#16.1(Vout)
NetQ?#4_2: Q?#4.2(G) U?#17.1(Vout)
NetQ?#5_2: Q?#5.2(G) U?#18.1(Vout)
NetQ?#6_2: Q?#6.2(G) U?#19.1(Vout)
NetQ?#7_2: Q?#7.2(G) U?#20.1(Vout)
NetQ?#8_2: Q?#8.2(G) U?#21.1(Vout)
NetQ?#9_2: Q?#9.2(G) U?#22.1(Vout)
NetQ?#10_2: Q?#10.2(G) U?#23.1(Vout)
NetQ?#11_2: Q?#11.2(G) U?#34.1(Vout)
NetQ?#12_2: Q?#12.2(G) U?#35.1(Vout)
NetQ?#13_2: Q?#13.2(G) U?#36.1(Vout)
NetQ?#14_2: Q?#14.2(G) U?#37.1(Vout)
NetQ?#15_2: Q?#15.2(G) U?#38.1(Vout)
NetQ?#16_2: Q?#16.2(G) U?#39.1(Vout)
NetQ?#17_2: Q?#17.2(G) U?#40.1(Vout)
NetQ?#18_2: Q?#18.2(G) U?#41.1(Vout)
NetQ?#19_2: Q?#19.2(G) U?#42.1(Vout)
NetQ?#20_2: Q?#20.2(G) U?#43.1(Vout)
NetQ?#21_2: Q?#21.2(G) U?#54.1(Vout)
NetQ?#22_2: Q?#22.2(G) U?#55.1(Vout)
NetQ?#23_2: Q?#23.2(G) U?#61.1(Vout)